# EAGLE schematic Resistor_Resistor (EAGLE 8.3.0), part 3 of 43
## Parts (continued)
R2940  10K  RESISTOR_0201  [0201]
R2941  10K  RESISTOR_0201  [0201]
R2942  10K  RESISTOR_0201  [0201]
R2943  10K  RESISTOR_0201  [0201]
R2944  10K  RESISTOR_0201  [0201]
R2945  10K  RESISTOR_0201  [0201]
R2946  10K  RESISTOR_0201  [0201]
R2947  10K  RESISTOR_0201  [0201]
R2948  10K  RESISTOR_0201  [0201]
R2949  10K  RESISTOR_0201  [0201]
R2950  10K  RESISTOR_0201  [0201]
R2951  10K  RESISTOR_0201  [0201]
R2952  10K  RESISTOR_0201  [0201]
R2953  10K  RESISTOR_0201  [0201]
R2954  10K  RESISTOR_0201  [0201]
R2955  10K  RESISTOR_0201  [0201]
R2956  10K  RESISTOR_0201  [0201]
R2957  10K  RESISTOR_0201  [0201]
R2958  10K  RESISTOR_0201  [0201]
R2959  10K  RESISTOR_0201  [0201]
R2960  10K  RESISTOR_0201  [0201]
R2961  10K  RESISTOR_0201  [0201]
R2962  10K  RESISTOR_0201  [0201]
R2963  10K  RESISTOR_0201  [0201]
R2964  10K  RESISTOR_0201  [0201]
R2965  10K  RESISTOR_0201  [0201]
R2966  10K  RESISTOR_0201  [0201]
R2967  10K  RESISTOR_0201  [0201]
R2968  10K  RESISTOR_0201  [0201]
R2969  10K  RESISTOR_0201  [0201]
R2970  10K  RESISTOR_0201  [0201]
R2971  10K  RESISTOR_0201  [0201]
R2972  10K  RESISTOR_0201  [0201]
R2973  10K  RESISTOR_0201  [0201]
R2974  10K  RESISTOR_0201  [0201]
R2975  10K  RESISTOR_0201  [0201]
R2976  10K  RESISTOR_0201  [0201]
R2977  10K  RESISTOR_0201  [0201]
R2978  10K  RESISTOR_0201  [0201]
R2979  10K  RESISTOR_0201  [0201]
R2980  10K  RESISTOR_0201  [0201]
R2981  10K  RESISTOR_0201  [0201]
R2982  10K  RESISTOR_0201  [0201]
R2983  10K  RESISTOR_0201  [0201]
R2984  10K  RESISTOR_0201  [0201]
R2985  10K  RESISTOR_0201  [0201]
R2986  10K  RESISTOR_0201  [0201]
R2987  10K  RESISTOR_0201  [0201]
R2988  10K  RESISTOR_0201  [0201]
R2989  10K  RESISTOR_0201  [0201]
R2990  10K  RESISTOR_0201  [0201]
R2991  10K  RESISTOR_0201  [0201]
R2992  10K  RESISTOR_0201  [0201]
R2993  10K  RESISTOR_0201  [0201]
R2994  10K  RESISTOR_0201  [0201]
R2995  10K  RESISTOR_0201  [0201]
R2996  10K  RESISTOR_0201  [0201]
R2997  10K  RESISTOR_0201  [0201]
R2998  10K  RESISTOR_0201  [0201]
R2999  10K  RESISTOR_0201  [0201]
R3000  10K  RESISTOR_0201  [0201]
R3001  10K  RESISTOR_0201  [0201]
R3002  10K  RESISTOR_0201  [0201]
R3003  10K  RESISTOR_0201  [0201]
R3004  10K  RESISTOR_0201  [0201]
R3005  10K  RESISTOR_0201  [0201]
R3006  10K  RESISTOR_0201  [0201]
R3007  10K  RESISTOR_0201  [0201]
R3008  10K  RESISTOR_0201  [0201]
R3009  10K  RESISTOR_0201  [0201]
R3010  10K  RESISTOR_0201  [0201]
R3011  10K  RESISTOR_0201  [0201]
R3012  10K  RESISTOR_0201  [0201]
R3013  10K  RESISTOR_0201  [0201]
R3014  10K  RESISTOR_0201  [0201]
R3015  10K  RESISTOR_0201  [0201]
R3016  10K  RESISTOR_0201  [0201]
R3017  10K  RESISTOR_0201  [0201]
R3018  10K  RESISTOR_0201  [0201]
R3019  10K  RESISTOR_0201  [0201]
R3020  10K  RESISTOR_0201  [0201]
R3021  10K  RESISTOR_0201  [0201]
R3022  10K  RESISTOR_0201  [0201]
R3023  10K  RESISTOR_0201  [0201]
R3024  10K  RESISTOR_0201  [0201]
R3025  10K  RESISTOR_0201  [0201]
R3026  10K  RESISTOR_0201  [0201]
R3027  10K  RESISTOR_0201  [0201]
R3028  10K  RESISTOR_0201  [0201]
R3029  10K  RESISTOR_0201  [0201]
R3030  10K  RESISTOR_0201  [0201]
R3031  10K  RESISTOR_0201  [0201]
R3032  10K  RESISTOR_0201  [0201]
R3033  10K  RESISTOR_0201  [0201]
R3034  10K  RESISTOR_0201  [0201]
R3035  10K  RESISTOR_0201  [0201]
R3036  10K  RESISTOR_0201  [0201]
R3037  10K  RESISTOR_0201  [0201]
R3038  10K  RESISTOR_0201  [0201]
R3039  10K  RESISTOR_0201  [0201]
R3040  10K  RESISTOR_0201  [0201]
R3041  10K  RESISTOR_0201  [0201]
R3042  10K  RESISTOR_0201  [0201]
R3043  10K  RESISTOR_0201  [0201]
R3044  10K  RESISTOR_0201  [0201]
R3045  10K  RESISTOR_0201  [0201]
R3046  10K  RESISTOR_0201  [0201]
R3047  10K  RESISTOR_0201  [0201]
R3048  10K  RESISTOR_0201  [0201]
R3049  10K  RESISTOR_0201  [0201]
R3050  10K  RESISTOR_0201  [0201]
R3051  10K  RESISTOR_0201  [0201]
R3052  10K  RESISTOR_0201  [0201]
R3053  10K  RESISTOR_0201  [0201]
R3054  10K  RESISTOR_0201  [0201]
R3055  10K  RESISTOR_0201  [0201]
R3056  10K  RESISTOR_0201  [0201]
R3057  10K  RESISTOR_0201  [0201]
R3058  10K  RESISTOR_0201  [0201]
R3059  10K  RESISTOR_0201  [0201]
R3060  10K  RESISTOR_0201  [0201]
R3061  10K  RESISTOR_0201  [0201]
R3062  10K  RESISTOR_0201  [0201]
R3063  10K  RESISTOR_0201  [0201]
R3064  10K  RESISTOR_0201  [0201]
R3065  10K  RESISTOR_0201  [0201]
R3066  10K  RESISTOR_0201  [0201]
R3067  10K  RESISTOR_0201  [0201]
R3068  10K  RESISTOR_0201  [0201]
R3069  10K  RESISTOR_0201  [0201]
R3070  10K  RESISTOR_0201  [0201]
R3071  10K  RESISTOR_0201  [0201]
R3072  10K  RESISTOR_0201  [0201]
R3073  10K  RESISTOR_0201  [0201]
R3074  10K  RESISTOR_0201  [0201]
R3075  10K  RESISTOR_0201  [0201]
R3076  10K  RESISTOR_0201  [0201]
R3077  10K  RESISTOR_0201  [0201]
R3078  10K  RESISTOR_0201  [0201]
R3079  10K  RESISTOR_0201  [0201]
R3080  10K  RESISTOR_0201  [0201]
R3081  10K  RESISTOR_0201  [0201]
R3082  10K  RESISTOR_0201  [0201]
R3083  10K  RESISTOR_0201  [0201]
R3084  10K  RESISTOR_0201  [0201]
R3085  10K  RESISTOR_0201  [0201]
R3086  10K  RESISTOR_0201  [0201]
R3087  10K  RESISTOR_0201  [0201]
R3088  10K  RESISTOR_0201  [0201]
R3089  10K  RESISTOR_0201  [0201]
R3090  10K  RESISTOR_0201  [0201]
R3091  10K  RESISTOR_0201  [0201]
R3092  10K  RESISTOR_0201  [0201]
R3093  10K  RESISTOR_0201  [0201]
R3094  10K  RESISTOR_0201  [0201]
R3095  10K  RESISTOR_0201  [0201]
R3096  10K  RESISTOR_0201  [0201]
R3097  10K  RESISTOR_0201  [0201]
R3098  10K  RESISTOR_0201  [0201]
R3099  10K  RESISTOR_0201  [0201]
R3100  10K  RESISTOR_0201  [0201]
R3101  10K  RESISTOR_0201  [0201]
R3102  10K  RESISTOR_0201  [0201]
R3103  10K  RESISTOR_0201  [0201]
R3104  10K  RESISTOR_0201  [0201]
R3105  10K  RESISTOR_0201  [0201]
R3106  10K  RESISTOR_0201  [0201]
R3107  10K  RESISTOR_0201  [0201]
R3108  10K  RESISTOR_0201  [0201]
R3109  10K  RESISTOR_0201  [0201]
R3110  10K  RESISTOR_0201  [0201]
R3111  10K  RESISTOR_0201  [0201]
R3112  10K  RESISTOR_0201  [0201]
R3113  10K  RESISTOR_0201  [0201]
R3114  10K  RESISTOR_0201  [0201]
R3115  10K  RESISTOR_0201  [0201]
R3116  10K  RESISTOR_0201  [0201]
R3117  10K  RESISTOR_0201  [0201]
R3118  10K  RESISTOR_0201  [0201]
R3119  10K  RESISTOR_0201  [0201]
R3120  10K  RESISTOR_0201  [0201]
R3121  10K  RESISTOR_0201  [0201]
R3122  10K  RESISTOR_0201  [0201]
R3123  10K  RESISTOR_0201  [0201]
R3124  10K  RESISTOR_0201  [0201]
R3125  10K  RESISTOR_0201  [0201]
R3126  10K  RESISTOR_0201  [0201]
R3127  10K  RESISTOR_0201  [0201]
R3128  10K  RESISTOR_0201  [0201]
R3129  10K  RESISTOR_0201  [0201]
R3130  10K  RESISTOR_0201  [0201]
R3131  10K  RESISTOR_0201  [0201]
R3132  10K  RESISTOR_0201  [0201]
R3133  10K  RESISTOR_0201  [0201]
R3134  10K  RESISTOR_0201  [0201]
R3135  10K  RESISTOR_0201  [0201]
R3136  10K  RESISTOR_0201  [0201]
R3137  10K  RESISTOR_0201  [0201]
R3138  10K  RESISTOR_0201  [0201]
R3139  10K  RESISTOR_0201  [0201]
R3140  10K  RESISTOR_0201  [0201]
R3141  10K  RESISTOR_0201  [0201]
R3142  10K  RESISTOR_0201  [0201]
R3143  10K  RESISTOR_0201  [0201]
R3144  10K  RESISTOR_0201  [0201]
R3145  10K  RESISTOR_0201  [0201]
R3146  10K  RESISTOR_0201  [0201]
R3147  10K  RESISTOR_0201  [0201]
R3148  10K  RESISTOR_0201  [0201]
R3149  10K  RESISTOR_0201  [0201]
R3150  10K  RESISTOR_0201  [0201]
R3151  10K  RESISTOR_0201  [0201]
R3152  10K  RESISTOR_0201  [0201]
R3153  10K  RESISTOR_0201  [0201]
R3154  10K  RESISTOR_0201  [0201]
R3155  10K  RESISTOR_0201  [0201]
R3156  10K  RESISTOR_0201  [0201]
R3157  10K  RESISTOR_0201  [0201]
R3158  10K  RESISTOR_0201  [0201]
R3159  10K  RESISTOR_0201  [0201]
R3160  10K  RESISTOR_0201  [0201]
R3161  10K  RESISTOR_0201  [0201]
R3162  10K  RESISTOR_0201  [0201]
R3163  10K  RESISTOR_0201  [0201]
R3164  10K  RESISTOR_0201  [0201]
R3165  10K  RESISTOR_0201  [0201]
R3166  10K  RESISTOR_0201  [0201]
R3167  10K  RESISTOR_0201  [0201]
R3168  10K  RESISTOR_0201  [0201]
R3169  10K  RESISTOR_0201  [0201]
R3170  10K  RESISTOR_0201  [0201]
R3171  10K  RESISTOR_0201  [0201]
R3172  10K  RESISTOR_0201  [0201]
R3173  10K  RESISTOR_0201  [0201]
R3174  10K  RESISTOR_0201  [0201]
R3175  10K  RESISTOR_0201  [0201]
R3176  10K  RESISTOR_0201  [0201]
R3177  10K  RESISTOR_0201  [0201]
R3178  10K  RESISTOR_0201  [0201]
R3179  10K  RESISTOR_0201  [0201]
R3180  10K  RESISTOR_0201  [0201]
R3181  10K  RESISTOR_0201  [0201]
R3182  10K  RESISTOR_0201  [0201]
R3183  10K  RESISTOR_0201  [0201]
R3184  10K  RESISTOR_0201  [0201]
R3185  10K  RESISTOR_0201  [0201]
R3186  10K  RESISTOR_0201  [0201]
R3187  10K  RESISTOR_0201  [0201]
R3188  10K  RESISTOR_0201  [0201]
R3189  10K  RESISTOR_0201  [0201]
R3190  10K  RESISTOR_0201  [0201]
R3191  10K  RESISTOR_0201  [0201]
R3192  10K  RESISTOR_0201  [0201]
R3193  10K  RESISTOR_0201  [0201]
R3194  10K  RESISTOR_0201  [0201]
R3195  10K  RESISTOR_0201  [0201]
R3196  10K  RESISTOR_0201  [0201]
R3197  10K  RESISTOR_0201  [0201]
R3198  10K  RESISTOR_0201  [0201]
R3199  10K  RESISTOR_0201  [0201]
R3200  10K  RESISTOR_0201  [0201]
R3201  10K  RESISTOR_0201  [0201]
R3202  10K  RESISTOR_0201  [0201]
R3203  10K  RESISTOR_0201  [0201]
R3204  10K  RESISTOR_0201  [0201]
R3205  10K  RESISTOR_0201  [0201]
R3206  10K  RESISTOR_0201  [0201]
R3207  10K  RESISTOR_0201  [0201]
R3208  10K  RESISTOR_0201  [0201]
R3209  10K  RESISTOR_0201  [0201]
R3210  10K  RESISTOR_0201  [0201]
R3211  10K  RESISTOR_0201  [0201]
R3212  10K  RESISTOR_0201  [0201]
R3213  10K  RESISTOR_0201  [0201]
R3214  10K  RESISTOR_0201  [0201]
R3215  10K  RESISTOR_0201  [0201]
R3216  10K  RESISTOR_0201  [0201]
R3217  10K  RESISTOR_0201  [0201]
R3218  10K  RESISTOR_0201  [0201]
R3219  10K  RESISTOR_0201  [0201]
R3220  10K  RESISTOR_0201  [0201]
R3221  10K  RESISTOR_0201  [0201]
R3222  10K  RESISTOR_0201  [0201]
R3223  10K  RESISTOR_0201  [0201]
R3224  10K  RESISTOR_0201  [0201]
R3225  10K  RESISTOR_0201  [0201]
R3226  10K  RESISTOR_0201  [0201]
R3227  10K  RESISTOR_0201  [0201]
R3228  10K  RESISTOR_0201  [0201]
R3229  10K  RESISTOR_0201  [0201]
R3230  10K  RESISTOR_0201  [0201]
R3231  10K  RESISTOR_0201  [0201]
R3232  10K  RESISTOR_0201  [0201]
R3233  10K  RESISTOR_0201  [0201]
R3234  10K  RESISTOR_0201  [0201]
R3235  10K  RESISTOR_0201  [0201]
R3236  10K  RESISTOR_0201  [0201]
R3237  10K  RESISTOR_0201  [0201]
R3238  10K  RESISTOR_0201  [0201]
R3239  10K  RESISTOR_0201  [0201]
R3240  10K  RESISTOR_0201  [0201]
R3241  10K  RESISTOR_0201  [0201]
R3242  10K  RESISTOR_0201  [0201]
R3243  10K  RESISTOR_0201  [0201]
R3244  10K  RESISTOR_0201  [0201]
R3245  10K  RESISTOR_0201  [0201]
R3246  10K  RESISTOR_0201  [0201]
R3247  10K  RESISTOR_0201  [0201]
R3248  10K  RESISTOR_0201  [0201]
R3249  10K  RESISTOR_0201  [0201]
R3250  10K  RESISTOR_0201  [0201]
R3251  10K  RESISTOR_0201  [0201]
R3252  10K  RESISTOR_0201  [0201]
R3253  10K  RESISTOR_0201  [0201]
R3254  10K  RESISTOR_0201  [0201]
R3255  10K  RESISTOR_0201  [0201]
R3256  10K  RESISTOR_0201  [0201]
R3257  10K  RESISTOR_0201  [0201]
R3258  10K  RESISTOR_0201  [0201]
R3259  10K  RESISTOR_0201  [0201]
R3260  10K  RESISTOR_0201  [0201]
R3261  10K  RESISTOR_0201  [0201]
R3262  10K  RESISTOR_0201  [0201]
R3263  10K  RESISTOR_0201  [0201]
R3264  10K  RESISTOR_0201  [0201]
R3265  10K  RESISTOR_0201  [0201]
R3266  10K  RESISTOR_0201  [0201]
R3267  10K  RESISTOR_0201  [0201]
R3268  10K  RESISTOR_0201  [0201]
R3269  10K  RESISTOR_0201  [0201]
R3270  10K  RESISTOR_0201  [0201]
R3271  10K  RESISTOR_0201  [0201]
R3272  10K  RESISTOR_0201  [0201]
R3273  10K  RESISTOR_0201  [0201]
R3274  10K  RESISTOR_0201  [0201]
R3275  10K  RESISTOR_0201  [0201]
R3276  10K  RESISTOR_0201  [0201]
R3277  10K  RESISTOR_0201  [0201]
R3278  10K  RESISTOR_0201  [0201]
R3279  10K  RESISTOR_0201  [0201]
R3280  10K  RESISTOR_0201  [0201]
R3281  10K  RESISTOR_0201  [0201]
R3282  10K  RESISTOR_0201  [0201]
R3283  10K  RESISTOR_0201  [0201]
R3284  10K  RESISTOR_0201  [0201]
R3285  10K  RESISTOR_0201  [0201]
R3286  10K  RESISTOR_0201  [0201]
R3287  10K  RESISTOR_0201  [0201]
R3288  10K  RESISTOR_0201  [0201]
R3289  10K  RESISTOR_0201  [0201]
R3290  10K  RESISTOR_0201  [0201]
R3291  10K  RESISTOR_0201  [0201]
R3292  10K  RESISTOR_0201  [0201]
R3293  10K  RESISTOR_0201  [0201]
R3294  10K  RESISTOR_0201  [0201]
R3295  10K  RESISTOR_0201  [0201]
R3296  10K  RESISTOR_0201  [0201]
R3297  10K  RESISTOR_0201  [0201]
R3298  10K  RESISTOR_0201  [0201]
R3299  10K  RESISTOR_0201  [0201]
R3300  10K  RESISTOR_0201  [0201]
R3301  10K  RESISTOR_0201  [0201]
R3302  10K  RESISTOR_0201  [0201]
R3303  10K  RESISTOR_0201  [0201]
R3304  10K  RESISTOR_0201  [0201]
R3305  10K  RESISTOR_0201  [0201]
R3306  10K  RESISTOR_0201  [0201]
R3307  10K  RESISTOR_0201  [0201]
R3308  10K  RESISTOR_0201  [0201]
R3309  10K  RESISTOR_0201  [0201]
R3310  10K  RESISTOR_0201  [0201]
R3311  10K  RESISTOR_0201  [0201]
R3312  10K  RESISTOR_0201  [0201]
R3313  10K  RESISTOR_0201  [0201]
R3314  10K  RESISTOR_0201  [0201]
R3315  10K  RESISTOR_0201  [0201]
R3316  10K  RESISTOR_0201  [0201]
R3317  10K  RESISTOR_0201  [0201]
R3318  10K  RESISTOR_0201  [0201]
R3319  10K  RESISTOR_0201  [0201]
R3320  10K  RESISTOR_0201  [0201]
R3321  10K  RESISTOR_0201  [0201]
R3322  10K  RESISTOR_0201  [0201]
R3323  10K  RESISTOR_0201  [0201]
R3324  10K  RESISTOR_0201  [0201]
R3325  10K  RESISTOR_0201  [0201]
R3326  10K  RESISTOR_0201  [0201]
R3327  10K  RESISTOR_0201  [0201]
R3328  10K  RESISTOR_0201  [0201]
R3329  10K  RESISTOR_0201  [0201]
R3330  10K  RESISTOR_0201  [0201]
R3331  10K  RESISTOR_0201  [0201]
R3332  10K  RESISTOR_0201  [0201]
R3333  10K  RESISTOR_0201  [0201]
R3334  10K  RESISTOR_0201  [0201]
R3335  10K  RESISTOR_0201  [0201]
R3336  10K  RESISTOR_0201  [0201]
R3337  10K  RESISTOR_0201  [0201]
R3338  10K  RESISTOR_0201  [0201]
R3339  10K  RESISTOR_0201  [0201]
R3340  10K  RESISTOR_0201  [0201]
R3341  10K  RESISTOR_0201  [0201]
R3342  10K  RESISTOR_0201  [0201]
R3343  10K  RESISTOR_0201  [0201]
R3344  10K  RESISTOR_0201  [0201]
R3345  10K  RESISTOR_0201  [0201]
R3346  10K  RESISTOR_0201  [0201]
R3347  10K  RESISTOR_0201  [0201]
R3348  10K  RESISTOR_0201  [0201]
R3349  10K  RESISTOR_0201  [0201]
R3350  10K  RESISTOR_0201  [0201]
R3351  10K  RESISTOR_0201  [0201]
R3352  10K  RESISTOR_0201  [0201]
R3353  10K  RESISTOR_0201  [0201]
R3354  10K  RESISTOR_0201  [0201]
R3355  10K  RESISTOR_0201  [0201]
R3356  10K  RESISTOR_0201  [0201]
R3357  10K  RESISTOR_0201  [0201]
R3358  10K  RESISTOR_0201  [0201]
R3359  10K  RESISTOR_0201  [0201]
R3360  10K  RESISTOR_0201  [0201]
R3361  10K  RESISTOR_0201  [0201]
R3362  10K  RESISTOR_0201  [0201]
R3363  10K  RESISTOR_0201  [0201]
R3364  10K  RESISTOR_0201  [0201]
R3365  10K  RESISTOR_0201  [0201]
R3366  10K  RESISTOR_0201  [0201]
R3367  10K  RESISTOR_0201  [0201]
R3368  10K  RESISTOR_0201  [0201]
R3369  10K  RESISTOR_0201  [0201]
R3370  10K  RESISTOR_0201  [0201]
R3371  10K  RESISTOR_0201  [0201]
R3372  10K  RESISTOR_0201  [0201]
R3373  10K  RESISTOR_0201  [0201]
R3374  10K  RESISTOR_0201  [0201]
R3375  10K  RESISTOR_0201  [0201]
R3376  10K  RESISTOR_0201  [0201]
R3377  10K  RESISTOR_0201  [0201]
R3378  10K  RESISTOR_0201  [0201]
R3379  10K  RESISTOR_0201  [0201]
R3380  10K  RESISTOR_0201  [0201]
R3381  10K  RESISTOR_0201  [0201]
R3382  10K  RESISTOR_0201  [0201]
R3383  10K  RESISTOR_0201  [0201]
R3384  10K  RESISTOR_0201  [0201]
R3385  10K  RESISTOR_0201  [0201]
R3386  10K  RESISTOR_0201  [0201]
R3387  10K  RESISTOR_0201  [0201]
R3388  10K  RESISTOR_0201  [0201]
R3389  10K  RESISTOR_0201  [0201]
R3390  10K  RESISTOR_0201  [0201]
R3391  10K  RESISTOR_0201  [0201]
R3392  10K  RESISTOR_0201  [0201]
R3393  10K  RESISTOR_0201  [0201]
R3394  10K  RESISTOR_0201  [0201]
R3395  10K  RESISTOR_0201  [0201]
R3396  10K  RESISTOR_0201  [0201]
R3397  10K  RESISTOR_0201  [0201]
R3398  10K  RESISTOR_0201  [0201]
R3399  10K  RESISTOR_0201  [0201]
R3400  10K  RESISTOR_0201  [0201]
R3401  10K  RESISTOR_0201  [0201]
R3402  10K  RESISTOR_0201  [0201]
R3403  10K  RESISTOR_0201  [0201]
R3404  10K  RESISTOR_0201  [0201]
R3405  10K  RESISTOR_0201  [0201]
R3406  10K  RESISTOR_0201  [0201]
R3407  10K  RESISTOR_0201  [0201]
R3408  10K  RESISTOR_0201  [0201]
R3409  10K  RESISTOR_0201  [0201]
R3410  10K  RESISTOR_0201  [0201]
R3411  10K  RESISTOR_0201  [0201]
R3412  10K  RESISTOR_0201  [0201]
R3413  10K  RESISTOR_0201  [0201]
R3414  10K  RESISTOR_0201  [0201]
R3415  10K  RESISTOR_0201  [0201]
R3416  10K  RESISTOR_0201  [0201]
R3417  10K  RESISTOR_0201  [0201]
R3418  10K  RESISTOR_0201  [0201]
R3419  10K  RESISTOR_0201  [0201]
R3420  10K  RESISTOR_0201  [0201]
R3421  10K  RESISTOR_0201  [0201]
R3422  10K  RESISTOR_0201  [0201]
R3423  10K  RESISTOR_0201  [0201]
R3424  10K  RESISTOR_0201  [0201]
R3425  10K  RESISTOR_0201  [0201]
R3426  10K  RESISTOR_0201  [0201]
R3427  10K  RESISTOR_0201  [0201]
R3428  10K  RESISTOR_0201  [0201]
R3429  10K  RESISTOR_0201  [0201]
R3430  10K  RESISTOR_0201  [0201]
R3431  10K  RESISTOR_0201  [0201]
R3432  10K  RESISTOR_0201  [0201]
R3433  10K  RESISTOR_0201  [0201]
R3434  10K  RESISTOR_0201  [0201]
R3435  10K  RESISTOR_0201  [0201]
R3436  10K  RESISTOR_0201  [0201]
R3437  10K  RESISTOR_0201  [0201]
R3438  10K  RESISTOR_0201  [0201]
R3439  10K  RESISTOR_0201  [0201]
R3440  10K  RESISTOR_0201  [0201]
R3441  10K  RESISTOR_0201  [0201]
R3442  10K  RESISTOR_0201  [0201]
R3443  10K  RESISTOR_0201  [0201]
R3444  10K  RESISTOR_0201  [0201]
R3445  10K  RESISTOR_0201  [0201]
R3446  10K  RESISTOR_0201  [0201]
R3447  10K  RESISTOR_0201  [0201]
R3448  10K  RESISTOR_0201  [0201]
R3449  10K  RESISTOR_0201  [0201]
R3450  10K  RESISTOR_0201  [0201]
R3451  10K  RESISTOR_0201  [0201]
R3452  10K  RESISTOR_0201  [0201]
R3453  10K  RESISTOR_0201  [0201]
R3454  10K  RESISTOR_0201  [0201]
R3455  10K  RESISTOR_0201  [0201]
R3456  10K  RESISTOR_0201  [0201]
R3457  10K  RESISTOR_0201  [0201]
R3458  10K  RESISTOR_0201  [0201]
R3459  10K  RESISTOR_0201  [0201]
R3460  10K  RESISTOR_0201  [0201]
R3461  10K  RESISTOR_0201  [0201]
R3462  10K  RESISTOR_0201  [0201]
R3463  10K  RESISTOR_0201  [0201]
R3464  10K  RESISTOR_0201  [0201]
R3465  10K  RESISTOR_0201  [0201]
R3466  10K  RESISTOR_0201  [0201]
R3467  10K  RESISTOR_0201  [0201]
R3468  10K  RESISTOR_0201  [0201]
R3469  10K  RESISTOR_0201  [0201]
R3470  10K  RESISTOR_0201  [0201]
R3471  10K  RESISTOR_0201  [0201]
R3472  10K  RESISTOR_0201  [0201]
R3473  10K  RESISTOR_0201  [0201]
R3474  10K  RESISTOR_0201  [0201]
R3475  10K  RESISTOR_0201  [0201]
R3476  10K  RESISTOR_0201  [0201]
R3477  10K  RESISTOR_0201  [0201]
R3478  10K  RESISTOR_0201  [0201]
R3479  10K  RESISTOR_0201  [0201]
R3480  10K  RESISTOR_0201  [0201]
R3481  10K  RESISTOR_0201  [0201]
R3482  10K  RESISTOR_0201  [0201]
R3483  10K  RESISTOR_0201  [0201]
R3484  10K  RESISTOR_0201  [0201]
R3485  10K  RESISTOR_0201  [0201]
R3486  10K  RESISTOR_0201  [0201]
R3487  10K  RESISTOR_0201  [0201]
R3488  10K  RESISTOR_0201  [0201]
R3489  10K  RESISTOR_0201  [0201]
R3490  10K  RESISTOR_0201  [0201]
R3491  10K  RESISTOR_0201  [0201]
R3492  10K  RESISTOR_0201  [0201]
R3493  10K  RESISTOR_0201  [0201]
R3494  10K  RESISTOR_0201  [0201]
R3495  10K  RESISTOR_0201  [0201]
R3496  10K  RESISTOR_0201  [0201]
R3497  10K  RESISTOR_0201  [0201]
R3498  10K  RESISTOR_0201  [0201]
R3499  10K  RESISTOR_0201  [0201]
R3500  10K  RESISTOR_0201  [0201]
R3501  10K  RESISTOR_0201  [0201]
R3502  10K  RESISTOR_0201  [0201]
R3503  10K  RESISTOR_0201  [0201]
R3504  10K  RESISTOR_0201  [0201]
R3505  10K  RESISTOR_0201  [0201]
R3506  10K  RESISTOR_0201  [0201]
R3507  10K  RESISTOR_0201  [0201]
R3508  10K  RESISTOR_0201  [0201]
R3509  10K  RESISTOR_0201  [0201]
R3510  10K  RESISTOR_0201  [0201]
R3511  10K  RESISTOR_0201  [0201]
R3512  10K  RESISTOR_0201  [0201]
R3513  10K  RESISTOR_0201  [0201]
R3514  10K  RESISTOR_0201  [0201]
R3515  10K  RESISTOR_0201  [0201]
R3516  10K  RESISTOR_0201  [0201]
R3517  10K  RESISTOR_0201  [0201]
R3518  10K  RESISTOR_0201  [0201]
R3519  10K  RESISTOR_0201  [0201]
R3520  10K  RESISTOR_0201  [0201]
R3521  10K  RESISTOR_0201  [0201]
R3522  10K  RESISTOR_0201  [0201]
R3523  10K  RESISTOR_0201  [0201]
R3524  10K  RESISTOR_0201  [0201]
R3525  10K  RESISTOR_0201  [0201]
R3526  10K  RESISTOR_0201  [0201]
R3527  10K  RESISTOR_0201  [0201]
R3528  10K  RESISTOR_0201  [0201]
R3529  10K  RESISTOR_0201  [0201]
R3530  10K  RESISTOR_0201  [0201]
R3531  10K  RESISTOR_0201  [0201]
R3532  10K  RESISTOR_0201  [0201]
R3533  10K  RESISTOR_0201  [0201]
R3534  10K  RESISTOR_0201  [0201]
R3535  10K  RESISTOR_0201  [0201]
R3536  10K  RESISTOR_0201  [0201]
R3537  10K  RESISTOR_0201  [0201]
R3538  10K  RESISTOR_0201  [0201]
R3539  10K  RESISTOR_0201  [0201]
R3540  10K  RESISTOR_0201  [0201]
R3541  10K  RESISTOR_0201  [0201]
R3542  10K  RESISTOR_0201  [0201]
R3543  10K  RESISTOR_0201  [0201]
R3544  10K  RESISTOR_0201  [0201]
R3545  10K  RESISTOR_0201  [0201]
R3546  10K  RESISTOR_0201  [0201]
R3547  10K  RESISTOR_0201  [0201]
R3548  10K  RESISTOR_0201  [0201]
R3549  10K  RESISTOR_0201  [0201]
R3550  10K  RESISTOR_0201  [0201]
R3551  10K  RESISTOR_0201  [0201]
R3552  10K  RESISTOR_0201  [0201]
R3553  10K  RESISTOR_0201  [0201]
R3554  10K  RESISTOR_0201  [0201]
R3555  10K  RESISTOR_0201  [0201]
R3556  10K  RESISTOR_0201  [0201]
R3557  10K  RESISTOR_0201  [0201]
R3558  10K  RESISTOR_0201  [0201]
R3559  10K  RESISTOR_0201  [0201]
R3560  10K  RESISTOR_0201  [0201]
R3561  10K  RESISTOR_0201  [0201]
R3562  10K  RESISTOR_0201  [0201]
R3563  10K  RESISTOR_0201  [0201]
R3564  10K  RESISTOR_0201  [0201]
R3565  10K  RESISTOR_0201  [0201]
R3566  10K  RESISTOR_0201  [0201]
R3567  10K  RESISTOR_0201  [0201]
R3568  10K  RESISTOR_0201  [0201]
R3569  10K  RESISTOR_0201  [0201]
R3570  10K  RESISTOR_0201  [0201]
R3571  10K  RESISTOR_0201  [0201]
R3572  10K  RESISTOR_0201  [0201]
R3573  10K  RESISTOR_0201  [0201]
R3574  10K  RESISTOR_0201  [0201]
R3575  10K  RESISTOR_0201  [0201]
R3576  10K  RESISTOR_0201  [0201]
R3577  10K  RESISTOR_0201  [0201]
R3578  10K  RESISTOR_0201  [0201]
R3579  10K  RESISTOR_0201  [0201]
R3580  10K  RESISTOR_0201  [0201]
R3581  10K  RESISTOR_0201  [0201]
R3582  10K  RESISTOR_0201  [0201]
R3583  10K  RESISTOR_0201  [0201]
R3584  10K  RESISTOR_0201  [0201]
R3585  10K  RESISTOR_0201  [0201]
R3586  10K  RESISTOR_0201  [0201]
R3587  10K  RESISTOR_0201  [0201]
R3588  10K  RESISTOR_0201  [0201]
R3589  10K  RESISTOR_0201  [0201]
R3590  10K  RESISTOR_0201  [0201]
R3591  10K  RESISTOR_0201  [0201]
R3592  10K  RESISTOR_0201  [0201]
R3593  10K  RESISTOR_0201  [0201]
R3594  10K  RESISTOR_0201  [0201]
R3595  10K  RESISTOR_0201  [0201]
R3596  10K  RESISTOR_0201  [0201]
R3597  10K  RESISTOR_0201  [0201]
R3598  10K  RESISTOR_0201  [0201]
R3599  10K  RESISTOR_0201  [0201]
R3600  10K  RESISTOR_0201  [0201]
R3601  10K  RESISTOR_0201  [0201]
R3602  10K  RESISTOR_0201  [0201]
R3603  10K  RESISTOR_0201  [0201]
R3604  10K  RESISTOR_0201  [0201]
R3605  10K  RESISTOR_0201  [0201]
R3606  10K  RESISTOR_0201  [0201]
R3607  10K  RESISTOR_0201  [0201]
R3608  10K  RESISTOR_0201  [0201]
R3609  10K  RESISTOR_0201  [0201]
R3610  10K  RESISTOR_0201  [0201]
R3611  10K  RESISTOR_0201  [0201]
R3612  10K  RESISTOR_0201  [0201]
R3613  10K  RESISTOR_0201  [0201]
R3614  10K  RESISTOR_0201  [0201]
R3615  10K  RESISTOR_0201  [0201]
R3616  10K  RESISTOR_0201  [0201]
R3617  10K  RESISTOR_0201  [0201]
R3618  10K  RESISTOR_0201  [0201]
R3619  10K  RESISTOR_0201  [0201]
R3620  10K  RESISTOR_0201  [0201]
R3621  10K  RESISTOR_0201  [0201]
R3622  10K  RESISTOR_0201  [0201]
R3623  10K  RESISTOR_0201  [0201]
R3624  10K  RESISTOR_0201  [0201]
R3625  10K  RESISTOR_0201  [0201]
R3626  10K  RESISTOR_0201  [0201]
R3627  10K  RESISTOR_0201  [0201]
R3628  10K  RESISTOR_0201  [0201]
R3629  10K  RESISTOR_0201  [0201]
R3630  10K  RESISTOR_0201  [0201]
R3631  10K  RESISTOR_0201  [0201]
R3632  10K  RESISTOR_0201  [0201]
R3633  10K  RESISTOR_0201  [0201]
R3634  10K  RESISTOR_0201  [0201]
R3635  10K  RESISTOR_0201  [0201]
R3636  10K  RESISTOR_0201  [0201]
R3637  10K  RESISTOR_0201  [0201]
R3638  10K  RESISTOR_0201  [0201]
R3639  10K  RESISTOR_0201  [0201]
R3640  10K  RESISTOR_0201  [0201]
R3641  10K  RESISTOR_0201  [0201]
R3642  10K  RESISTOR_0201  [0201]
R3643  10K  RESISTOR_0201  [0201]
R3644  10K  RESISTOR_0201  [0201]
R3645  10K  RESISTOR_0201  [0201]
R3646  10K  RESISTOR_0201  [0201]
R3647  10K  RESISTOR_0201  [0201]
R3648  10K  RESISTOR_0201  [0201]
R3649  10K  RESISTOR_0201  [0201]
R3650  10K  RESISTOR_0201  [0201]
R3651  10K  RESISTOR_0201  [0201]
R3652  10K  RESISTOR_0201  [0201]
R3653  10K  RESISTOR_0201  [0201]
R3654  10K  RESISTOR_0201  [0201]
R3655  10K  RESISTOR_0201  [0201]
R3656  10K  RESISTOR_0201  [0201]
R3657  10K  RESISTOR_0201  [0201]
R3658  10K  RESISTOR_0201  [0201]
R3659  10K  RESISTOR_0201  [0201]
R3660  10K  RESISTOR_0201  [0201]
R3661  10K  RESISTOR_0201  [0201]
R3662  10K  RESISTOR_0201  [0201]
R3663  10K  RESISTOR_0201  [0201]
R3664  10K  RESISTOR_0201  [0201]
R3665  10K  RESISTOR_0201  [0201]
R3666  10K  RESISTOR_0201  [0201]
R3667  10K  RESISTOR_0201  [0201]
R3668  10K  RESISTOR_0201  [0201]
R3669  10K  RESISTOR_0201  [0201]